# EasyEDA Pro project Designs.eprj, schematic Schematic4_1
Board Name: ArithmeticUnit; Create Date: 2026-04-14; Page Name: P1; Project Name: Designs; Schematic Name: Schematic4_1; Update Date: 2026-04-14; Company: EasyEDA.com; Page Size: A4; Version: V1.0
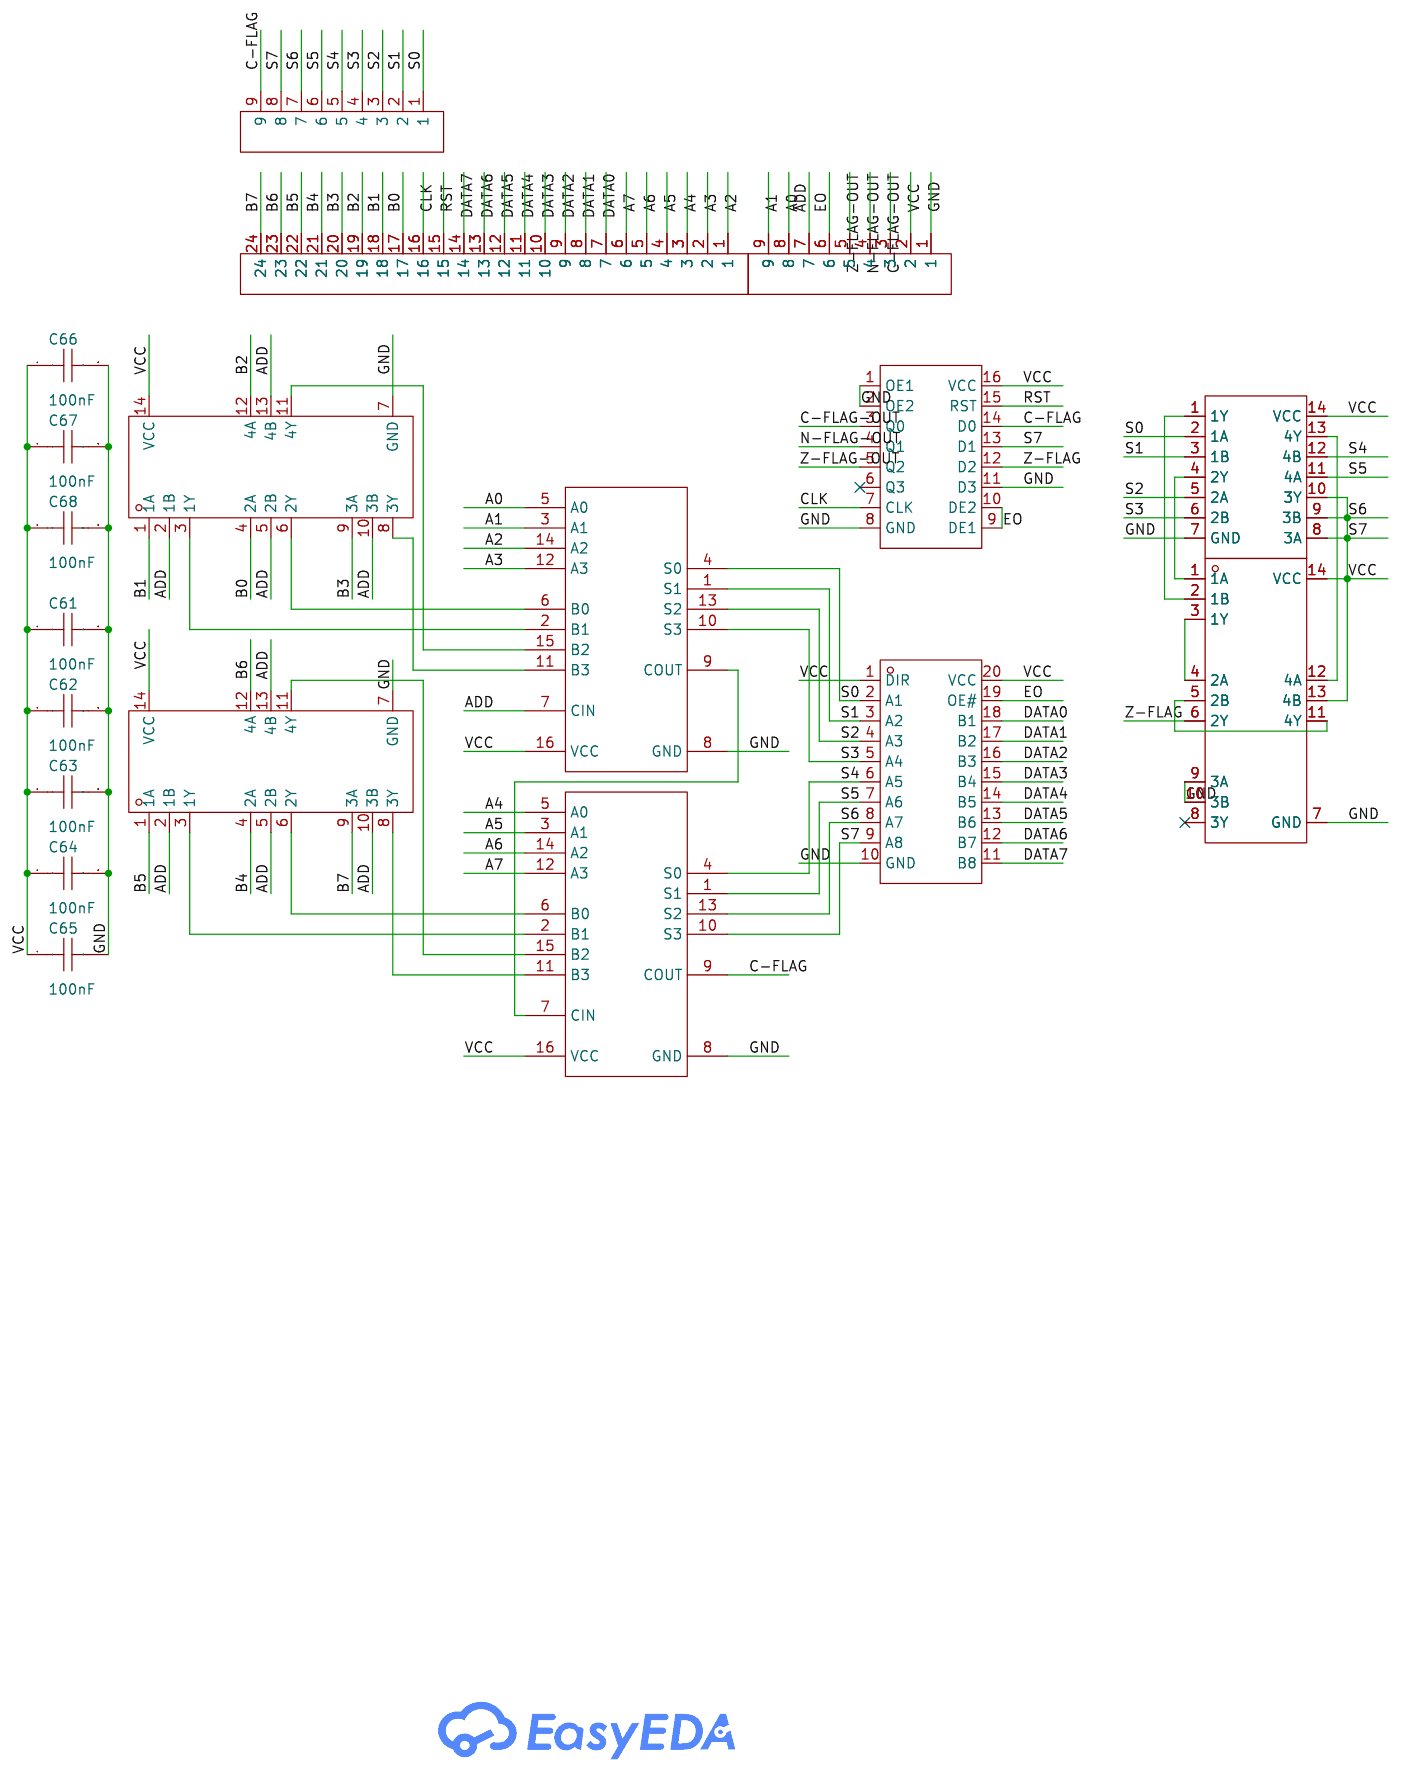
[diagram p2: schematic sheet]

## Parts
C61  100nF  [CAP-TH_L5.0-W2.5-P5.00-D1.0]
C62  100nF  [CAP-TH_L5.0-W2.5-P5.00-D1.0]
C63  100nF  [CAP-TH_L5.0-W2.5-P5.00-D1.0]
C64  100nF  [CAP-TH_L5.0-W2.5-P5.00-D1.0]
C65  100nF  [CAP-TH_L5.0-W2.5-P5.00-D1.0]
C66  100nF  [CAP-TH_L5.0-W2.5-P5.00-D1.0]
C67  100nF  [CAP-TH_L5.0-W2.5-P5.00-D1.0]
C68  100nF  [CAP-TH_L5.0-W2.5-P5.00-D1.0]
U9  CD74HC173E  [PDIP-16_L19.2-W6.6-P2.54-LS7.6-BL]
U69  74HC283P-E  [PDIP-16_L19.3-W6.4-P2.54-LS7.94-BL]
U70  SN74HC86N(LX)  [PDIP-14_L19.3-W6.5-P2.54-LS7.6-BL]
U237  SN74HC245N3  [PDIP-20_L25.9-W6.6-P2.54-LS7.9-BL]
U315  74HC02N  [DIP-14_L19.6-W6.4-P2.54-LS7.6-BL]
U316  SN74HC08NE4  [PDIP-14_L19.3-W6.5-P2.54-LS7.6-BL]
U317  74HC283P-E  [PDIP-16_L19.3-W6.4-P2.54-LS7.94-BL]
U318  SN74HC86N(LX)  [PDIP-14_L19.3-W6.5-P2.54-LS7.6-BL]
U384  TH2.54-24P排针(母)(邮寄专用)  [HDR-TH_24P-P2.54-V-F]
U388  HDR2.54-LI-9P  [HDR-TH_9P-P2.54-V-M]
U390  HDR2.54-LI-9P  [HDR-TH_9P-P2.54-V-M]

## Library data of the parts
C61-C68 = 178MU0006: LCSC Part Name: 100nF ±10% 50V; Supplier Part: C5632430; Manufacturer: KNSCHA(科尼盛); Supplier Footprint: 插件,P=2.54mm; JLCPCB Part Class: Extended Part; Datasheet: https://item.szlcsc.com/datasheet/178MU0006/6552585.html; Supplier: LCSC; Tolerance: ±10%; Voltage Rating: 50V; Temperature Coefficient: X7R; Pin Spacing: 2.54mm
U9 = CD74HC173E: LCSC Part Name: 三态高速CMOS逻辑四路D型触发器; Supplier Part: C1549968; Manufacturer: TI(德州仪器); Supplier Footprint: PDIP-16; JLCPCB Part Class: Extended Part; Datasheet: https://www.ti.com/cn/lit/gpn/cd74hct173; Supplier: LCSC; Type: D-Type; Trigger Type: Rising Edge; Voltage - Supply: 2V~6V; Clock Frequency: 60MHz; Function: Reset; Number of Elements: 1; Number of Bits per Element: 4; Output Type: Tri-State; Propagation Delay: 34ns@6V,50pF; Series: 74HC Series; Current - Output Low(IOL): 7.8mA; Current - Output High(IOH): 7.8mA; Quiescent Current: 8uA; Input Capacitance: 10pF; Operating Temperature: -55℃~+125℃; Setup Time: 12ns; Hold Time: 3ns
U69 U317 = 74HC283P-E: Supplier Part: C17688236; Manufacturer: RENESAS(瑞萨)/IDT; Datasheet: https://item.szlcsc.com/datasheet/74HC283P-E/18817510.html; Supplier: LCSC
U70 U318 = SN74HC86N(LX): LCSC Part Name: 集成电路; Supplier Part: C22436661; Manufacturer: LX(灵星芯微); Supplier Footprint: DIP-14; JLCPCB Part Class: Extended Part; Datasheet: https://atta.szlcsc.com/upload/public/pdf/source/20240524/675B1C928075FFB7AC00BEC82378813F.pdf; Supplier: LCSC; Logic Type: XOR Gate; Number of Channels: 4; Voltage - Supply: 2V~6V; Quiescent Current: 2uA; Input Logic Level - High: 1.5V~4.2V; Input Logic Level - Low: 500mV~1.8V; Series: 74HCSeries; Operating Temperature: -40℃~+125℃
U237 = SN74HC245N3: Supplier Part: C3587488; Manufacturer: TI(德州仪器); Supplier Footprint: PDIP-20; JLCPCB Part Class: Extended Part; Datasheet: https://item.szlcsc.com/datasheet/SN74HC245N3/4154202.html; Supplier: LCSC; output type: Tri-State; Voltage - Supply: 2V~6V; Number of Elements: 1; Number of Bits per Element: 8; Channel Type: Bidirectional; Current - Output Low(IOL): 7.8mA; Current - Output High(IOH): 7.8mA; Logic Family: 74HC; Operating Temperature: -40℃~+85℃; Quiescent Current: 80uA; Propagation Delay: 21ns@4.5V,50pF
U315 = 74HC02N: LCSC Part Name: 四路 2 输入 或非门; Supplier Part: C507193; Manufacturer: HGSEMI(华冠); Supplier Footprint: DIP-14; JLCPCB Part Class: Extended Part; Datasheet: https://item.szlcsc.com/datasheet/74HC02N/520631.html; Supplier: LCSC; Logic Type: NOR Gate; Number of Channels: 4; Voltage - Supply: 2V~6V; Quiescent Current: 40uA; Current - Output Low(IOL): 25mA; Current - Output High(IOH): 25mA; Input Logic Level - High: 2.1V~4.2V; Input Logic Level - Low: 900mV~1.8V; Output Logic Level - High: 4.4V~5.9V; Output Logic Level - Low: 100mV; Series: 74HC Series; Propagation Delay: 13ns@4.5V,50pF; Operating Temperature: -40℃~+85℃; Input Number: 2
U316 = SN74HC08NE4: Supplier Part: C20345708; Manufacturer: TI(德州仪器); Supplier Footprint: PDIP-14; JLCPCB Part Class: Extended Part; Datasheet: https://item.szlcsc.com/datasheet/SN74HC08NE4/21671235.html; Supplier: LCSC; Logic Type: AND Gate; Number of Channels: 4; Voltage - Supply: 2V~6V; Quiescent Current: 20uA; Current - Output Low(IOL): 5.2mA; Current - Output High(IOH): 5.2mA; Input Logic Level - High: 1.5V；4.2V；3.15V; Input Logic Level - Low: 1.35V；500mV；1.8V; Output Logic Level - High: 4.4V；5.9V；1.9V; Output Logic Level - Low: 330mV；260mV；100mV; Series: 74HC; Propagation Delay: 25ns@4.5V,50pF; Operating Temperature: -40℃~+85℃; Input Number: 2
U384 = TH2.54-24P排针(母)(邮寄专用): Supplier Part: C9900014057; Supplier Footprint: HDR-TH_24P-P2.54-V-M; JLCPCB Part Class: Extended Part; Supplier: LCSC
U388 U390 = HDR2.54-LI-9P: Supplier Part: C9900020142; JLCPCB Part Class: Extended Part; Supplier: LCSC

## Nets
GND: C61.2 C62.2 C63.2 C64.2 C65.2 C66.2 C67.2 C68.2 U9.1(OE1) U9.2(OE2) U9.8(GND) U9.11(D3) U69.8(GND) U70.7(GND) U237.10(GND) U315.7(GND) U316.7(GND) U316.9(3A) U316.10(3B) U317.8(GND) U318.7(GND) U390.1
VCC: C61.1 C62.1 C63.1 C64.1 C65.1 C66.1 C67.1 C68.1 U9.16(VCC) U69.16(VCC) U70.14(VCC) U237.1(DIR) U237.20(VCC) U315.14(VCC) U316.14(VCC) U317.16(VCC) U318.14(VCC) U390.2
A0: U69.5(A0) U390.8
A1: U69.3(A1) U390.9
A2: U69.14(A2) U384.1
A3: U69.12(A3) U384.2
A4: U317.5(A0) U384.3
A5: U317.3(A1) U384.4
A6: U317.14(A2) U384.5
A7: U317.12(A3) U384.6
ADD: U69.7(CIN) U70.2(1B) U70.5(2B) U70.10(3B) U70.13(4B) U318.2(1B) U318.5(2B) U318.10(3B) U318.13(4B) U390.7
B0: U318.4(2A) U384.17
B1: U318.1(1A) U384.18
B2: U318.12(4A) U384.19
B3: U318.9(3A) U384.20
B4: U70.4(2A) U384.21
B5: U70.1(1A) U384.22
B6: U70.12(4A) U384.23
B7: U70.9(3A) U384.24
C-FLAG: U9.14(D0) U317.9(COUT) U388.9
C-FLAG-OUT: U9.3(Q0) U390.3
CLK: U9.7(CLK) U384.16
DATA0: U237.18(B1) U384.7
DATA1: U237.17(B2) U384.8
DATA2: U237.16(B3) U384.9
DATA3: U237.15(B4) U384.10
DATA4: U237.14(B5) U384.11
DATA5: U237.13(B6) U384.12
DATA6: U237.12(B7) U384.13
DATA7: U237.11(B8) U384.14
EO: U9.9(DE1) U9.10(DE2) U237.19(OE#) U390.6
N-FLAG-OUT: U9.4(Q1) U390.4
RST: U9.15(RST) U384.15
S0: U69.4(S0) U237.2(A1) U315.2(1A) U388.1
S1: U69.1(S1) U237.3(A2) U315.3(1B) U388.2
S2: U69.13(S2) U237.4(A3) U315.5(2A) U388.3
S3: U69.10(S3) U237.5(A4) U315.6(2B) U388.4
S4: U237.6(A5) U315.12(4B) U317.4(S0) U388.5
S5: U237.7(A6) U315.11(4A) U317.1(S1) U388.6
S6: U237.8(A7) U315.9(3B) U317.13(S2) U388.7
S7: U9.13(D1) U237.9(A8) U315.8(3A) U317.10(S3) U388.8
Z-FLAG: U9.12(D2) U316.6(2Y)
Z-FLAG-OUT: U9.5(Q2) U390.5
$1N764: U69.2(B1) U318.3(1Y)
$1N772: U69.6(B0) U318.6(2Y)
$1N777: U69.11(B3) U318.8(3Y)
$1N783: U69.15(B2) U318.11(4Y)
$1N810: U70.8(3Y) U317.11(B3)
$1N816: U70.11(4Y) U317.15(B2)
$1N3688: U316.3(1Y) U316.4(2A)
$1N3689: U316.5(2B) U316.11(4Y)
$1N3887: U70.6(2Y) U317.6(B0)
$1N3892: U70.3(1Y) U317.2(B1)
$1N6309: U69.9(COUT) U317.7(CIN)
$1N9251: U315.4(2Y) U316.1(1A)
$1N9257: U315.1(1Y) U316.2(1B)
$1N9267: U315.13(4Y) U316.12(4A)
$1N9273: U315.10(3Y) U316.13(4B)

Not connected (* = marked no-connect by the designer): U9 6(Q3)*; U316 8(3Y)*
